# EasyEDA Pro project C108_STM32.eprj, board PCB1
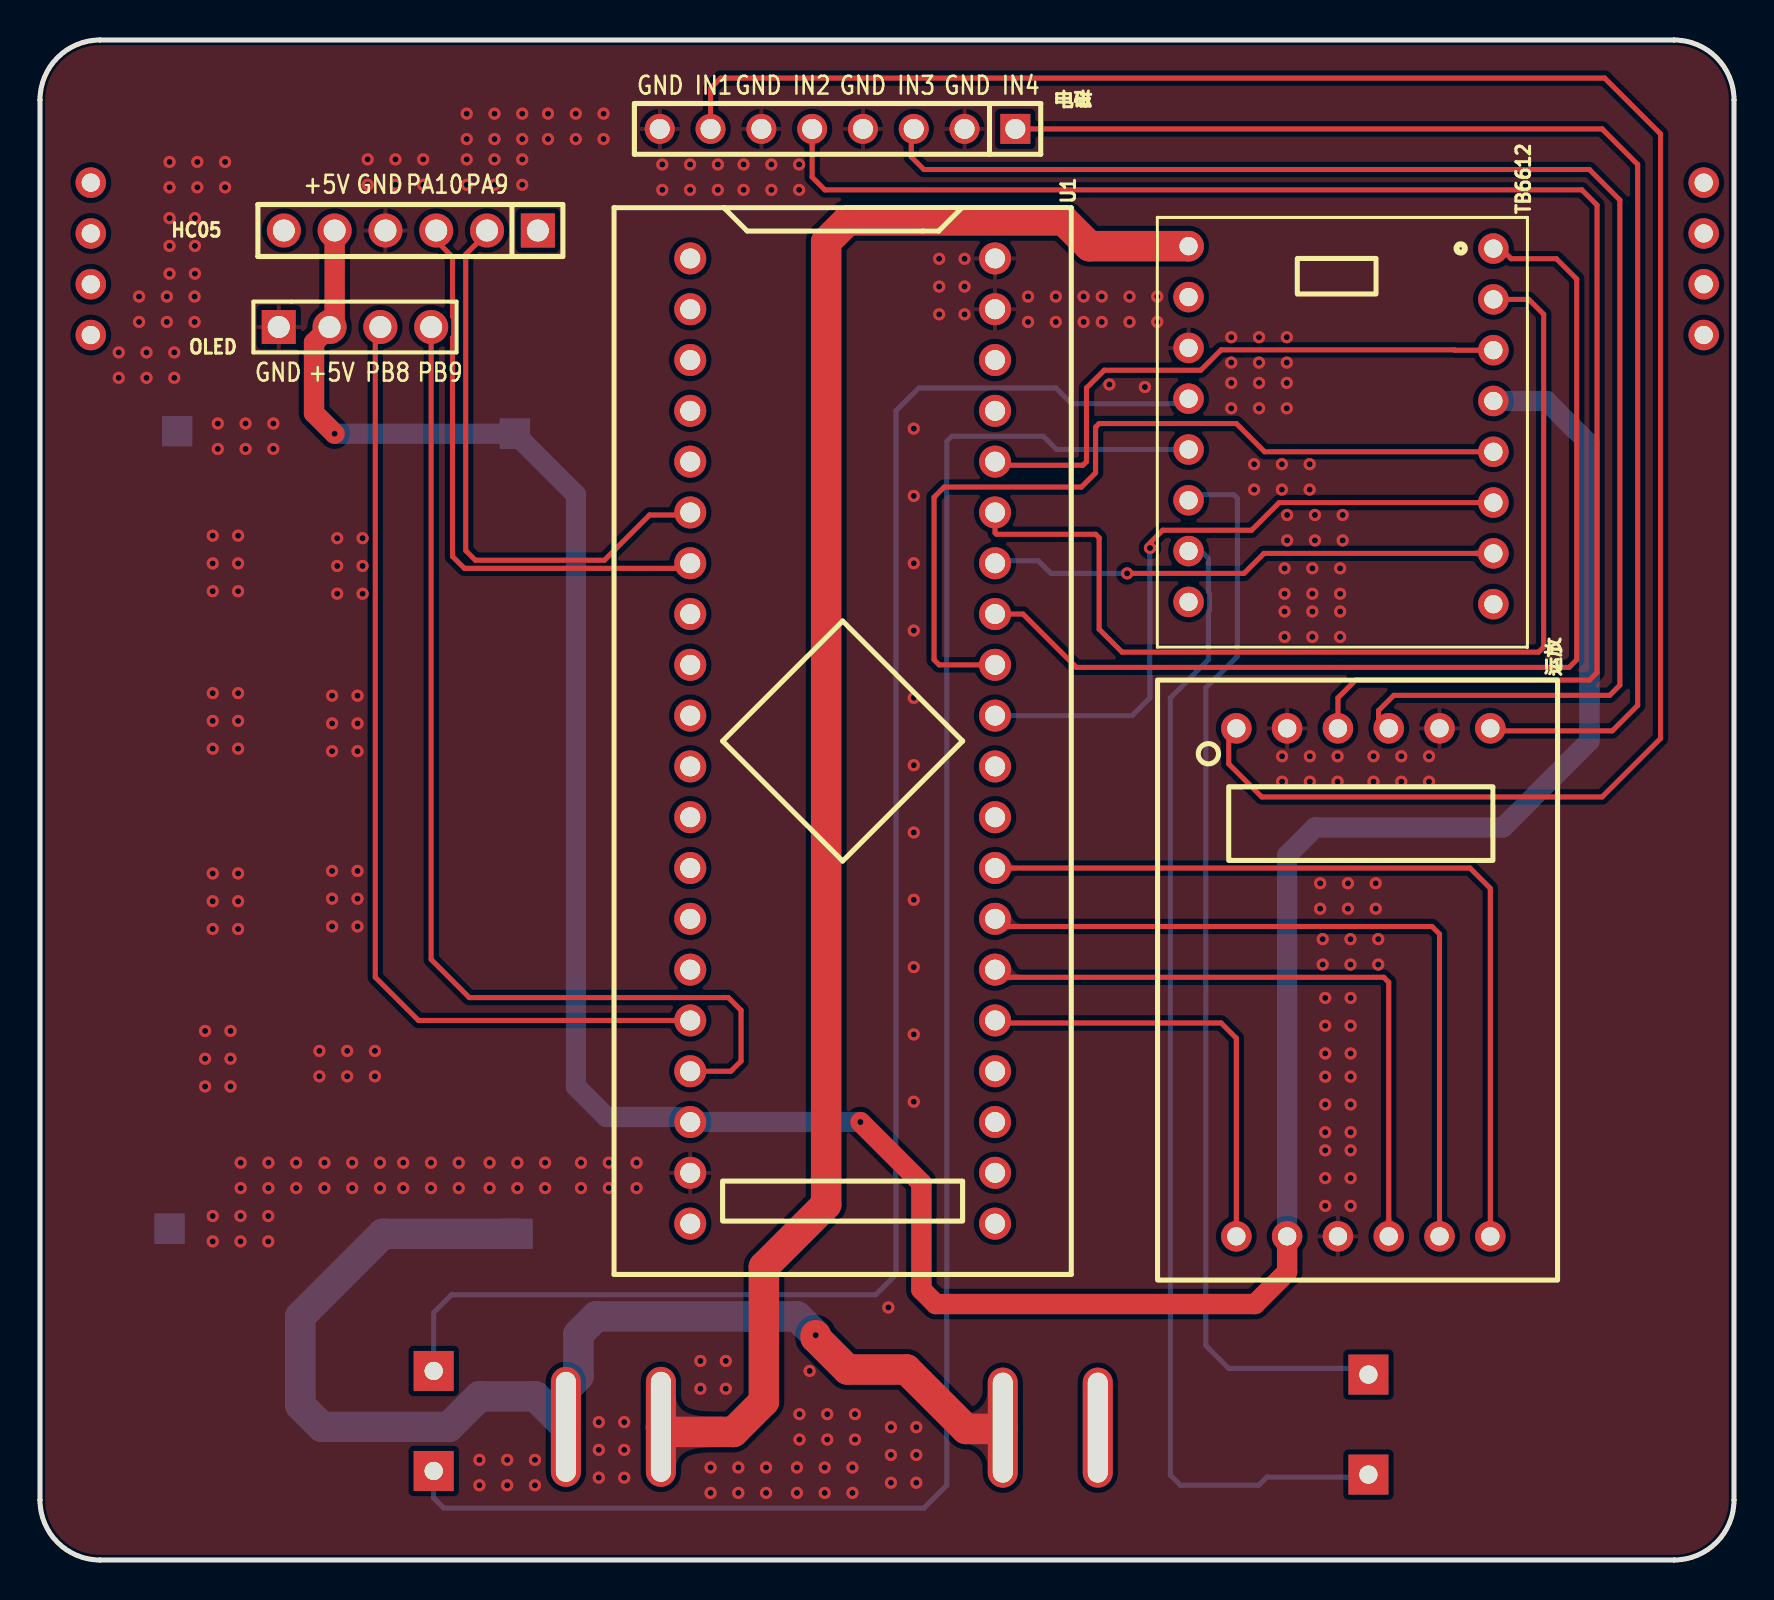
[diagram p9: board, top side]
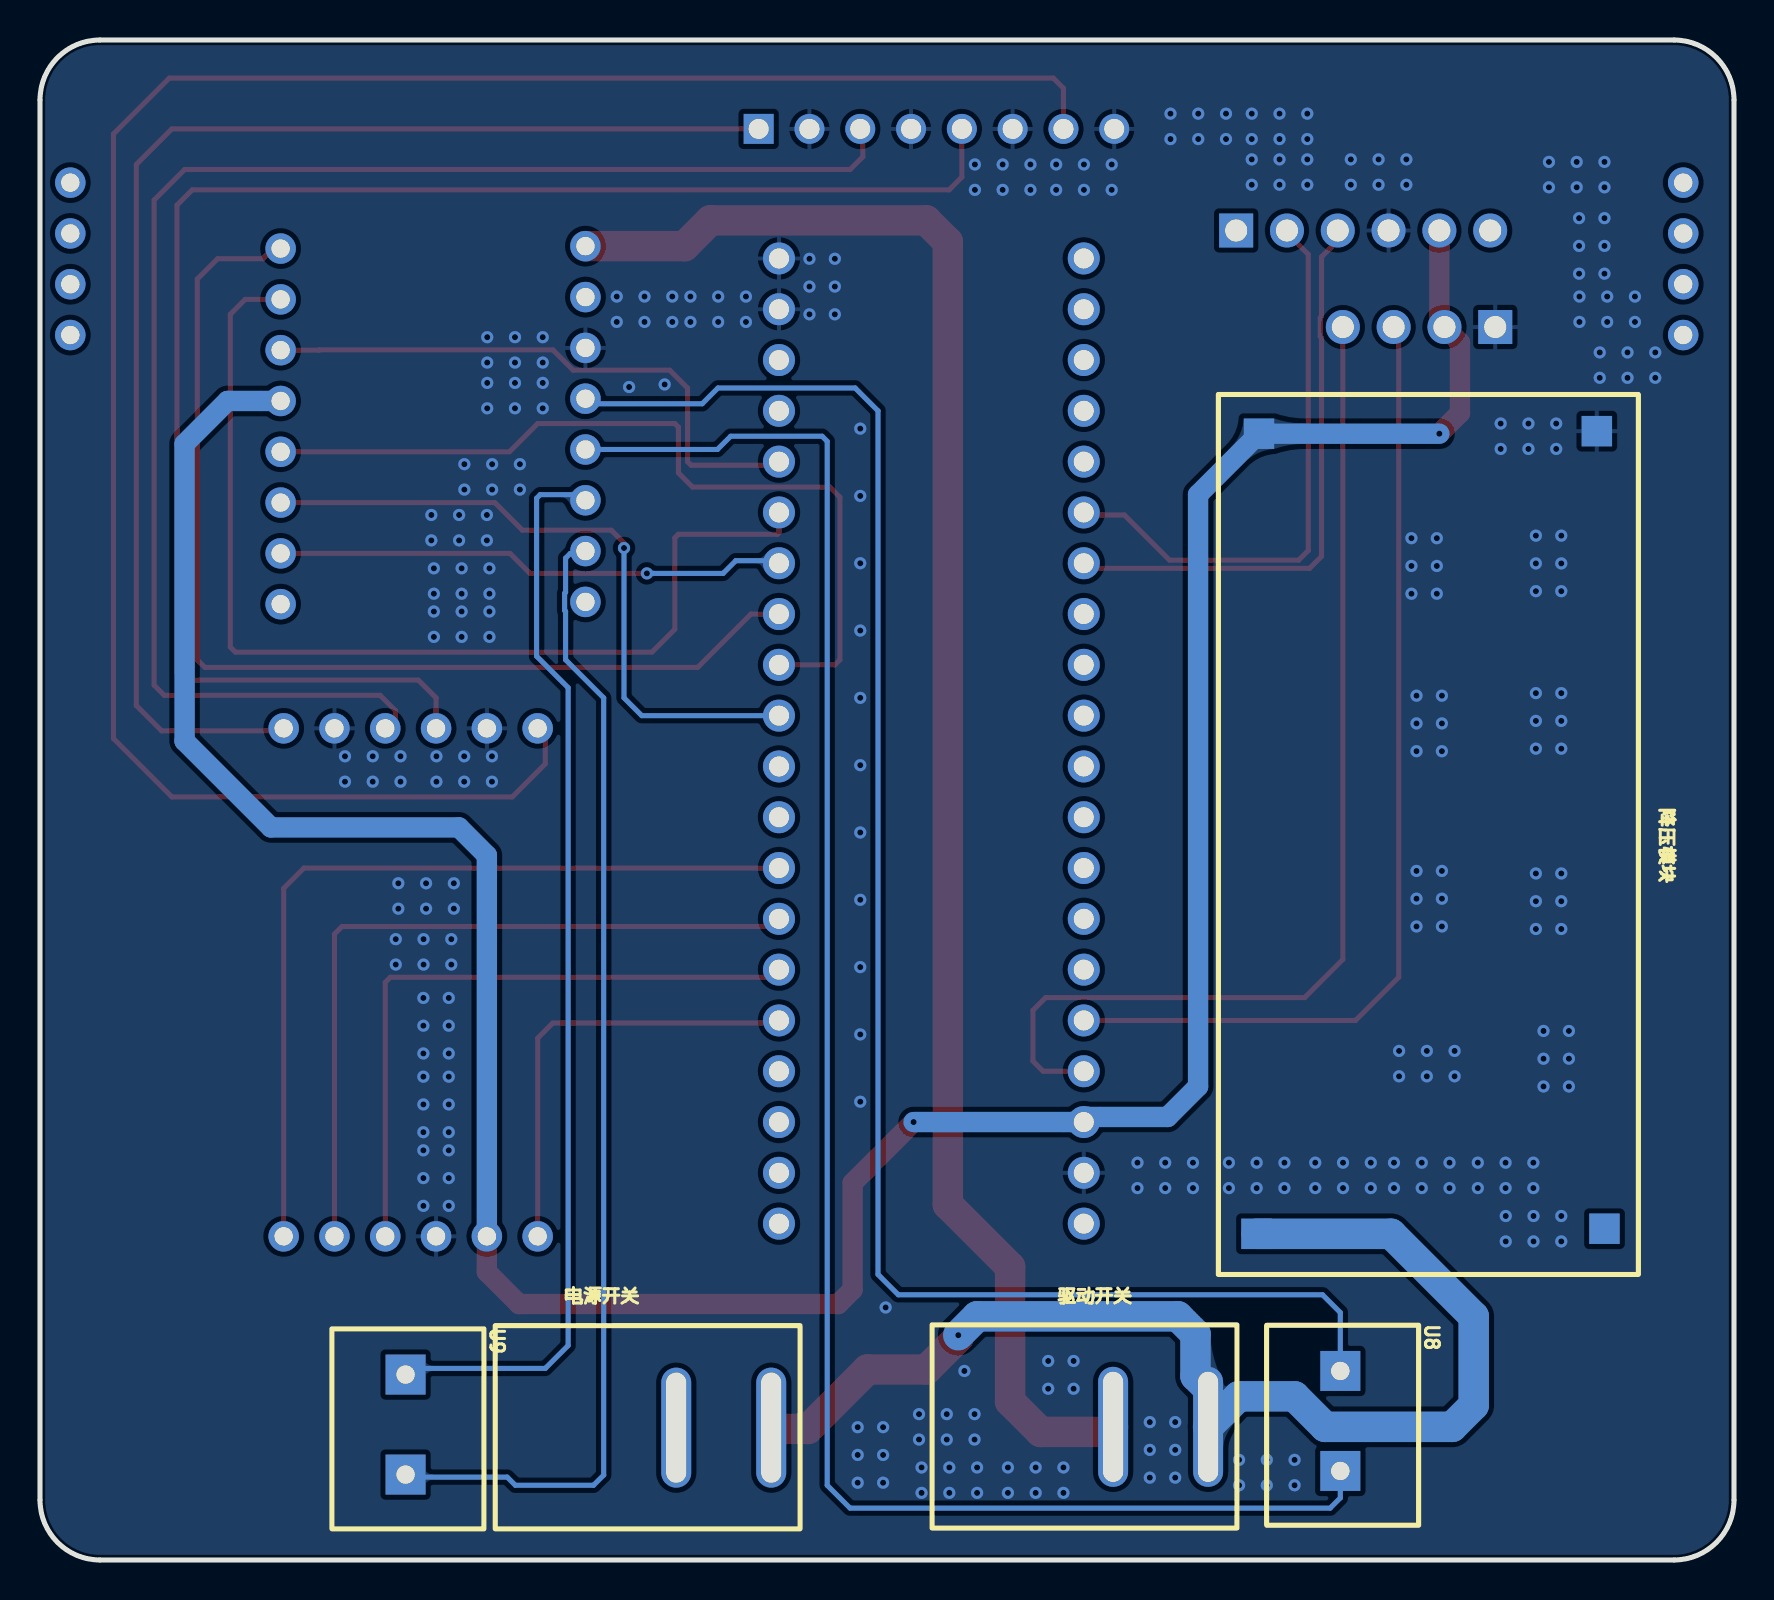
[diagram p10: board, bottom side, seen from below]

Outline 84.7 x 76 mm; copper layers: Top Layer, Bottom Layer. Coordinates in mm from the lower left corner of the outline.
Outline path: 0,73 0,3 arc(0.88,0.88) 3,0 81.7,0 arc(83.82,0.88) 84.7,3 84.7,73 arc(83.82,75.12) 81.7,76 3,76 arc(0.88,75.12) 0,73
Stack: Top Layer 0.035mm / Dielectric1 1.51mm FR4 er 4.5 / Bottom Layer 0.035mm

## Design rules (mm)
net PA9: DP1
net PA10: DP1
template: JLCPCB Capability(Two Layers Board)
spacing copperThickness1oz (default): track to track 0.102, other pairs 0.152 to 0.3
spacing copperThickness2oz: track to track 0.203, other pairs 0.152 to 0.3
track width copperThickness1oz (default): min 0.127, default 0.254, max 2.54
track width copperThickness2oz: min 0.203, default 0.254, max 2.54
differential pair differentialPair (default): width min 0.127, default 0.254, max 2.54; gap min 0.152, default 0.152
via viaSize (default): diameter min 0.5, default 0.61, max 10; hole min 0.3, default 0.305, max 6.3

## Placement (name value [footprint] x y rotation side)
HC05  HC05  [HDR-TH_6P-P2.54-V-M]  18.54 66.47 180 top
NOREF  -  [Pad_e1227]  83.19 66.33 0 top
NOREF#2  -  [Pad_e1219]  2.54 68.87 0 top
NOREF#3  -  [Pad_e1226]  83.19 63.79 0 top
NOREF#4  -  [Pad_e1221]  2.54 66.33 0 top
NOREF#5  -  [Pad_e1222]  2.54 63.79 0 top
NOREF#6  -  [Pad_e1225]  83.19 61.25 0 top
NOREF#7  -  [Pad_e1228]  83.19 68.87 0 top
NOREF#8  -  [Pad_e1223]  2.54 61.25 0 top
OLED  0.96 OLED  [HDR-TH_4P-P2.54-V-M-1]  15.75 61.65 0 top
TB6612  -  [TB6612_Board]  64.72 68.63 270 top
U1  STM32F103C8T6-Card  [CONN-TH_L53.3-W22.9_STM32F103C8T6-CARD]  40.13 40.95 270 top
U8  -  [端子]  23.5 11.61 270 bottom
U9  -  [端子]  70.23 11.43 270 bottom
电源开关  KCD1-101  [SW-TH_KCD1-101]  51.69 6.62 180 bottom
电磁  电感  [HDR-TH_8P-P2.54-V-M]  39.88 71.56 180 top
运放  -  [逐飞运放]  55.75 44.12 270 top
降压模块  -  [稳压模块]  25.91 14.15 90 bottom
驱动开关  KCD1-101  [SW-TH_KCD1-101]  29.85 6.66 180 bottom

## Footprints (pads in the part's own frame, mm; a bottom-side part is the same pattern mirrored in y, then rotated)
CONN-TH_L53.3-W22.9_STM32F103C8T6-CARD
  round 1.6 hole 1: 1(-24.13,-7.62) 2(-21.59,-7.62) 3(-19.05,-7.62) 4(-16.51,-7.62) 5(-13.97,-7.62) 6(-11.43,-7.62) 7(-8.89,-7.62) 8(-6.35,-7.62) 9(-3.81,-7.62) 10(-1.27,-7.62) 11(1.27,-7.62) 12(3.81,-7.62) 13(6.35,-7.62) 14(8.89,-7.62) 15(11.43,-7.62) 16(13.97,-7.62) 17(16.51,-7.62) 18(19.05,-7.62) 19(21.59,-7.62) 20(24.13,-7.62) 21(24.13,7.62) 22(21.59,7.62) 23(19.05,7.62) 24(16.51,7.62) 25(13.97,7.62) 26(11.43,7.62) 27(8.89,7.62) 28(6.35,7.62) 29(3.81,7.62) 30(1.27,7.62) 31(-1.27,7.62) 32(-3.81,7.62) 33(-6.35,7.62) 34(-8.89,7.62) 35(-11.43,7.62) 36(-13.97,7.62) 37(-16.51,7.62) 38(-19.05,7.62) 39(-21.59,7.62) 40(-24.13,7.62)
HDR-TH_4P-P2.54-V-M-1
  rect 1.7x1.7 hole 1.1: 1(-3.81,0)
  round 1.7 hole 1.1: 2(-1.27,0) 3(1.27,0) 4(3.81,0)
HDR-TH_6P-P2.54-V-M
  rect 1.7x1.7 hole 1.1: 1(-6.35,0)
  round 1.7 hole 1.1: 2(-3.81,0) 3(-1.27,0) 4(1.27,0) 5(3.81,0) 6(6.35,0)
HDR-TH_8P-P2.54-V-M
  rect 1.5x1.5 hole 1: 1(-8.89,0)
  round 1.5 hole 1: 2(-6.35,0) 3(-3.81,0) 4(-1.27,0) 5(1.27,0) 6(3.81,0) 7(6.35,0) 8(8.89,0)
Pad_e1219
  round 1.524 hole 0.914: 1(0,0)
Pad_e1221
  round 1.524 hole 0.914: 1(0,0)
Pad_e1222
  round 1.524 hole 0.914: 2(0,0)
Pad_e1223
  round 1.524 hole 0.914: 3(0,0)
Pad_e1225
  round 1.524 hole 0.914: 3(0,0)
Pad_e1226
  round 1.524 hole 0.914: 2(0,0)
Pad_e1227
  round 1.524 hole 0.914: 1(0,0)
Pad_e1228
  round 1.524 hole 0.914: 1(0,0)
SW-TH_KCD1-101
  oval 1.5x6 hole 1x5.5: 1(3.55,0) 2(-1.2,0)
TB6612_Board
  round 1.524 hole 0.914: 1(3.063,7.952) 2(5.603,7.952) 3(8.143,7.952) 4(10.683,7.952) 5(13.223,7.952) 6(15.763,7.952) 7(18.303,7.952) 8(20.843,7.952) 9(20.729,-7.288) 10(18.189,-7.288) 11(15.649,-7.288) 12(13.108,-7.288) 13(10.569,-7.288) 14(8.028,-7.288) 15(5.489,-7.288) 16(2.942,-7.288)
稳压模块
  rect 1.524x1.524 smd: 1(2.159,-2.032) 2(2.413,-19.431) 3(42.164,-2.159) 4(42.291,-19.05)
端子
  rect 2x2 hole 0.914: 1(2.159,3.81) 2(7.159,3.81)
逐飞运放
  round 1.524 hole 0.914: 1(2.54,4.064) 2(2.54,6.604) 3(2.54,9.144) 4(2.54,11.684) 5(2.54,14.224) 6(2.54,16.764) 7(27.94,4.064) 8(27.94,6.604) 9(27.94,9.144) 10(27.94,11.684) 11(27.94,14.224) 12(27.94,16.764)

## Nets
As in the schematic, except:
12V+: 电源开关.1 降压模块.1 驱动开关.1
$1N4047: TB6612.12 U8.2

Pads without a net: HC05 1 6; NOREF 1; NOREF#2 1; NOREF#3 2; NOREF#4 1; NOREF#5 2; NOREF#6 3; NOREF#7 1; NOREF#8 3; TB6612 8 9 15; U1 20 21 37 38

## Via types
v1: diameter 0.61, hole 0.305, Top Layer to Bottom Layer, 306 vias

## Routing (per net, layer and track width the routed paths; a pad name or vN(x,y) marks a point on that pad's centre or on a via; arc(x,y) is an arc through that point)
12V+: length 58.9
  Top Layer w1.524: 电源开关.1 48.08,6.55 46.3,6.55 43.33,9.53 40.37,9.53 38.79,11.11 v1(38.79,11.24)
  Bottom Layer w1.524: v1(38.79,11.24) 37.84,12.18 27.81,12.18 26.92,11.3 26.92,9.2 26.35,8.62 ; 驱动开关.1 24.77,8.18 21.97,8.18 20.45,6.66 14.09,6.66 13.02,7.74 13.02,12.18 17.14,16.31 降压模块.1
+5V: length 156.6
  Top Layer w1.016: 运放.8 62.36,14.41 60.75,12.8 44.79,12.8 44.07,13.52 44.07,18.85 v1(41.02,21.9) ; v1(14.73,56.31) 13.7,57.34 13.7,60.87 OLED.2 14.73,61.9 HC05.5
  Bottom Layer w1.016: TB6612.4 75.33,57.95 77.47,55.81 77.47,40.95 73.15,36.63 63.75,36.63 62.36,35.23 运放.8 ; v1(41.02,21.9) 32.51,21.9 32.26,22.15 28.32,22.15 26.8,23.68 26.8,53.27 降压模块.3 v1(14.73,56.31)
GND:
  vias: v1(3.94,60.38) v1(3.94,59.11) v1(4.95,63.17) v1(4.95,61.9) v1(5.33,60.38) v1(5.33,59.11) v1(6.34,63.17) v1(6.34,61.9) v1(6.48,69.9) v1(6.48,68.63) v1(6.48,67.09) v1(6.48,65.7) v1(6.48,64.32) v1(6.71,60.38) v1(6.71,59.11) v1(7.75,67.09) v1(7.75,65.7) v1(7.75,64.32) v1(7.73,63.17) v1(7.73,61.9) v1(7.87,69.9) v1(7.87,68.63) v1(8.26,26.45) v1(8.26,25.06) v1(8.26,23.68) v1(8.64,51.22) v1(8.64,49.83) v1(8.64,48.44) v1(8.64,43.34) v1(8.64,41.96) v1(8.64,40.57) v1(8.64,34.33) v1(8.64,32.94) v1(8.64,31.55) v1(8.64,17.2) v1(8.64,15.93) v1(8.89,56.82) v1(8.89,55.55) v1(9.25,69.9) v1(9.25,68.63) v1(9.53,26.45) v1(9.53,25.06) v1(9.53,23.68) v1(9.91,51.22) v1(9.91,49.83) v1(9.91,48.44) v1(9.91,43.34) v1(9.91,41.96) v1(9.91,40.57) v1(9.91,34.33) v1(9.91,32.94) v1(9.91,31.55) v1(10.03,19.87) v1(10.03,18.6) v1(10.02,17.2) v1(10.02,15.93) v1(10.28,56.82) v1(10.28,55.55) v1(11.42,19.87) v1(11.42,18.6) v1(11.41,17.2) v1(11.41,15.93) v1(11.67,56.82) v1(11.67,55.55) v1(12.81,19.87) v1(12.81,18.6) v1(13.97,25.45) v1(13.97,24.18) v1(14.22,19.87) v1(14.22,18.6) v1(14.61,43.22) v1(14.61,41.83) v1(14.61,40.44) v1(14.61,34.45) v1(14.61,33.07) v1(14.61,31.68) v1(14.86,51.09) v1(14.86,49.7) v1(14.86,48.31) v1(15.36,25.45) v1(15.36,24.18) v1(15.61,19.87) v1(15.61,18.6) v1(15.88,43.22) v1(15.88,41.83) v1(15.88,40.44) v1(15.88,34.45) v1(15.88,33.07) v1(15.88,31.68) v1(16.13,51.09) v1(16.13,49.7) v1(16.13,48.31) v1(16.38,70.03) v1(16.38,68.76) v1(16.75,25.45) v1(16.75,24.18) v1(17,19.87) v1(17,18.6) v1(17.77,70.03) v1(17.77,68.76) v1(18.16,19.87) v1(18.16,18.6) v1(19.16,70.03) v1(19.16,68.76) v1(19.55,19.87) v1(19.55,18.6) v1(20.94,19.87) v1(20.94,18.6) v1(21.34,72.32) v1(21.34,71.05) v1(21.34,70.03) v1(21.34,68.76) v1(21.97,5.01) v1(21.97,3.74) v1(22.48,19.87) v1(22.48,18.6) v1(22.72,72.32) v1(22.72,71.05) v1(22.72,70.03) v1(22.72,68.76) v1(23.36,5.01) v1(23.36,3.74) v1(23.87,19.87) v1(23.87,18.6) v1(24.11,72.32) v1(24.11,71.05) v1(24.11,70.03) v1(24.11,68.76) v1(24.75,5.01) v1(24.75,3.74) v1(25.26,19.87) v1(25.26,18.6) v1(25.4,72.32) v1(25.4,71.05) v1(26.79,72.32) v1(26.79,71.05) v1(27.05,19.87) v1(27.05,18.6) v1(27.94,6.89) v1(27.94,5.51) v1(27.94,4.12) v1(28.18,72.32) v1(28.18,71.05) v1(28.44,19.87) v1(28.44,18.6) v1(29.21,6.89) v1(29.21,5.51) v1(29.21,4.12) v1(29.83,19.87) v1(29.83,18.6) v1(31.11,69.78) v1(31.11,68.51) v1(32.5,69.78) v1(32.5,68.51) v1(33.02,9.95) v1(33.02,8.56) v1(33.53,4.63) v1(33.53,3.36) v1(33.89,69.78) v1(33.89,68.51) v1(34.29,9.95) v1(34.29,8.56) v1(34.92,4.63) v1(34.92,3.36) v1(35.18,69.78) v1(35.18,68.51) v1(36.3,4.63) v1(36.3,3.36) v1(36.57,69.78) v1(36.57,68.51) v1(37.85,4.63) v1(37.85,3.36) v1(37.96,69.78) v1(37.96,68.51) v1(37.97,7.29) v1(37.97,6.02) v1(38.48,9.45) v1(39.23,4.63) v1(39.23,3.36) v1(39.36,7.29) v1(39.36,6.02) v1(40.62,4.63) v1(40.62,3.36) v1(40.75,7.29) v1(40.75,6.02) v1(42.42,12.63) v1(42.55,6.64) v1(42.55,5.25) v1(42.55,3.86) v1(43.69,56.57) v1(43.69,53.2) v1(43.69,49.84) v1(43.69,46.47) v1(43.69,43.11) v1(43.69,39.74) v1(43.69,36.38) v1(43.69,33.01) v1(43.69,29.64) v1(43.69,26.28) v1(43.69,22.91) v1(43.82,6.64) v1(43.82,5.25) v1(43.82,3.86) v1(44.96,65.06) v1(44.96,63.67) v1(44.96,62.28) v1(46.23,65.06) v1(46.23,63.67) v1(46.23,62.28) v1(49.4,63.17) v1(49.4,61.9) v1(50.79,63.17) v1(50.79,61.9) v1(52.18,63.17) v1(52.18,61.9) v1(53.09,63.17) v1(53.09,61.9) v1(53.47,58.78) v1(54.47,63.17) v1(54.47,61.9) v1(55.24,58.65) v1(55.86,63.17) v1(55.86,61.9) v1(59.56,61.14) v1(59.56,59.87) v1(59.56,58.86) v1(59.56,57.58) v1(60.71,54.79) v1(60.71,53.52) v1(60.95,61.14) v1(60.95,59.87) v1(60.95,58.86) v1(60.95,57.58) v1(62.09,54.79) v1(62.09,53.52) v1(62.1,40.19) v1(62.1,38.92) v1(62.23,49.58) v1(62.23,48.31) v1(62.23,47.42) v1(62.23,46.16) v1(62.34,61.14) v1(62.34,59.87) v1(62.34,58.86) v1(62.34,57.58) v1(62.36,52.25) v1(62.36,50.98) v1(63.48,54.79) v1(63.48,53.52) v1(63.49,40.19) v1(63.49,38.92) v1(63.62,49.58) v1(63.62,48.31) v1(63.62,47.42) v1(63.62,46.16) v1(63.75,52.25) v1(63.75,50.98) v1(64.01,33.84) v1(64.01,32.57) v1(64.14,31.04) v1(64.14,29.77) v1(64.26,28.1) v1(64.26,26.72) v1(64.26,25.33) v1(64.26,24.17) v1(64.26,22.78) v1(64.26,21.39) v1(64.26,20.48) v1(64.26,19.1) v1(64.26,17.71) v1(64.88,40.19) v1(64.88,38.92) v1(65.01,49.58) v1(65.01,48.31) v1(65.01,47.42) v1(65.01,46.16) v1(65.13,52.25) v1(65.13,50.98) v1(65.4,33.84) v1(65.4,32.57) v1(65.52,31.04) v1(65.52,29.77) v1(65.53,28.1) v1(65.53,26.72) v1(65.53,25.33) v1(65.53,24.17) v1(65.53,22.78) v1(65.53,21.39) v1(65.53,20.48) v1(65.53,19.1) v1(65.53,17.71) v1(66.67,40.19) v1(66.67,38.92) v1(66.78,33.84) v1(66.78,32.57) v1(66.91,31.04) v1(66.91,29.77) v1(68.06,40.19) v1(68.06,38.92) v1(69.45,40.19) v1(69.45,38.92)
PA0: length 22.3
  Top Layer w0.254: U1.25 47.88,26.85 59.05,26.85 59.82,26.09 运放.7
PA1: length 32.6
  Top Layer w0.254: U1.26 48.13,29.14 67.18,29.14 67.44,28.88 运放.10
PA2: length 37.7
  Top Layer w0.254: 运放.11 69.98,31.3 69.6,31.68 48.13,31.68 U1.27
PA3: length 42.6
  Top Layer w0.254: U1.28 71.5,34.6 72.52,33.58 运放.12
PA6: length 33.9
  Top Layer w0.254: TB6612.6 61.96,52.87 60.58,51.49 56.13,51.49 55.5,50.85 v1(55.5,50.6)
  Bottom Layer w0.254: v1(55.5,50.6) 55.5,43.11 54.61,42.22 U1.31
PA7: length 42.7
  Top Layer w0.254: U1.32 44.96,44.76 44.7,45.01 44.7,53.14 45.21,53.65 52.07,53.65 52.78,54.36 52.78,56.64 52.96,56.82 59.82,56.82 61.23,55.41 TB6612.5
PA9: length 28.9
  Top Layer w0.254: HC05.2 22.35,66.35 21.28,65.28 21.28,50.47 21.77,49.99 28.22,49.99 30.48,52.25 32.39,52.25 32.51,52.38
PA10: length 28.9
  Top Layer w0.254: HC05.3 19.81,65.97 20.62,65.15 20.62,62.18 20.69,62.12 20.69,61.18 20.62,61.12 20.62,50.18 21.22,49.58 32.26,49.58 32.51,49.84
PB0: length 54.2
  Top Layer w0.254: TB6612.1 73.05,65.57 73.56,65.06 75.82,65.06 76.83,64.05 76.83,45.01 76.45,44.63 51.82,44.63 49.15,47.3 U1.33
PB1: length 25.6
  Top Layer w0.254: TB6612.7 61.2,50.33 60.2,49.33 v1(54.36,49.33)
  Bottom Layer w0.254: U1.34 47.88,49.97 49.91,49.97 50.55,49.33 v1(54.36,49.33)
PB8: length 49.3
  Top Layer w0.254: OLED.3 16.76,61.39 16.76,29.14 18.92,26.98 32.51,26.98
PB9: length 53.5
  Top Layer w0.254: OLED.4 19.56,30.03 21.46,28.12 34.42,28.12 35.05,27.49 35.05,24.95 34.54,24.44 32.51,24.44
PB10: length 53.2
  Top Layer w0.254: U1.35 47.75,51.36 47.83,51.29 52.78,51.29 52.96,51.11 52.96,46.54 54.1,45.39 74.93,45.39 75.18,45.65 75.18,62.28 74.44,63.03 TB6612.2
PB11: length 29.5
  Top Layer w0.254: TB6612.3 70.75,60.49 70.74,60.51 59.05,60.51 58.04,59.49 53.21,59.49 52.32,58.6 52.32,54.92 52.14,54.74 47.93,54.74 U1.36
$1N3334: length 84.3
  Top Layer w1.524: 驱动开关.2 31.3,6.4 34.67,6.4 36.2,7.93 36.2,14.66 39.31,17.77 39.31,65.91 40.39,66.98 51.18,66.98 52.47,65.69 TB6612.16
$1N4039: length 85.5
  Bottom Layer w0.254: U8.1 19.69,12.37 20.57,13.26 41.78,13.26 42.8,14.28 42.8,57.46 43.94,58.6 50.8,58.6 51.59,57.81 57.17,57.81 TB6612.13
$1N4047: length 92.4
  Bottom Layer w0.254: U8.2 19.69,3.1 20.19,2.59 44.2,2.59 45.34,3.74 45.34,55.93 45.59,56.19 50.17,56.19 50.83,55.53 TB6612.12
$1N4051: length 54.5
  Bottom Layer w0.254: TB6612.11 57.43,53.11 57.58,53.27 59.69,53.27 59.87,53.09 59.87,45.19 58.29,43.61 58.29,10.72 59.44,9.58 66.11,9.58 66.42,9.27
$1N4057: length 58.2
  Bottom Layer w0.254: 66.42,4.27 66.29,4.15 61.34,4.15 60.93,3.74 57.02,3.74 56.52,4.25 56.52,43.11 58.42,45.01 58.42,47.42 58.47,47.47 58.47,48.34 58.42,48.39 58.42,50.09 58.19,50.32 57.55,50.32 TB6612.10 57.43,50.47
$1N4971: length 106.3
  Top Layer w0.254: 电磁.7 33.53,73.59 34.04,74.09 78.23,74.09 81.03,71.3 81.03,41.08 78.11,38.15 61.09,38.15 59.44,39.81 59.44,41.46
$1N5000: length 80.9
  Top Layer w0.254: 64.52,41.46 64.9,41.84 64.9,43.11 65.79,44 77.47,44 77.85,44.38 77.85,67.75 77.09,68.51 39.24,68.51 38.61,69.14 电磁.5
$1N5005: length 75.7
  Top Layer w0.254: 67.06,41.46 66.93,41.58 66.93,42.47 67.69,43.23 78.49,43.23 78.99,43.74 78.99,68 77.47,69.52 44.2,69.52 43.56,70.16 43.56,71.43 电磁.3
$1N5016: length 67.2
  Top Layer w0.254: 48.77,71.56 78.11,71.56 79.88,69.78 79.88,42.73 78.61,41.46 72.14,41.46

## Copper pours and planes (outline as drawn; the poured copper is in the pictures)
GND on Top Layer: -3.17,77.27 87.88,77.27 87.88,-1.72 -3.17,-1.72
GND on Bottom Layer: -3.36,77.27 86.87,77.27 86.87,-0.84 -3.36,-0.84

Small or netless copper shapes (teardrops, artwork), in the pictures only: 12 on Top Layer, 14 on Bottom Layer

## Text on the board
Top Silkscreen Layer: GND | +5V | PB8 | PA10 | PB9 | PA9 | IN1 | IN2 | IN3 | IN4
